# Altium schematic sheet ProjectDescription.SchDoc: =ProjectName
size A3; Author: Hena Chernov; CompanyName: Catcatcat Electronics; Engineer: Hena Chernov; SheetNumber: 1; SheetTotal: 10; Designer: Catcatcat; SheetDescription: Description Project; Email: catcatcat.electronics@gmail.com; CodePhone: +380505759863
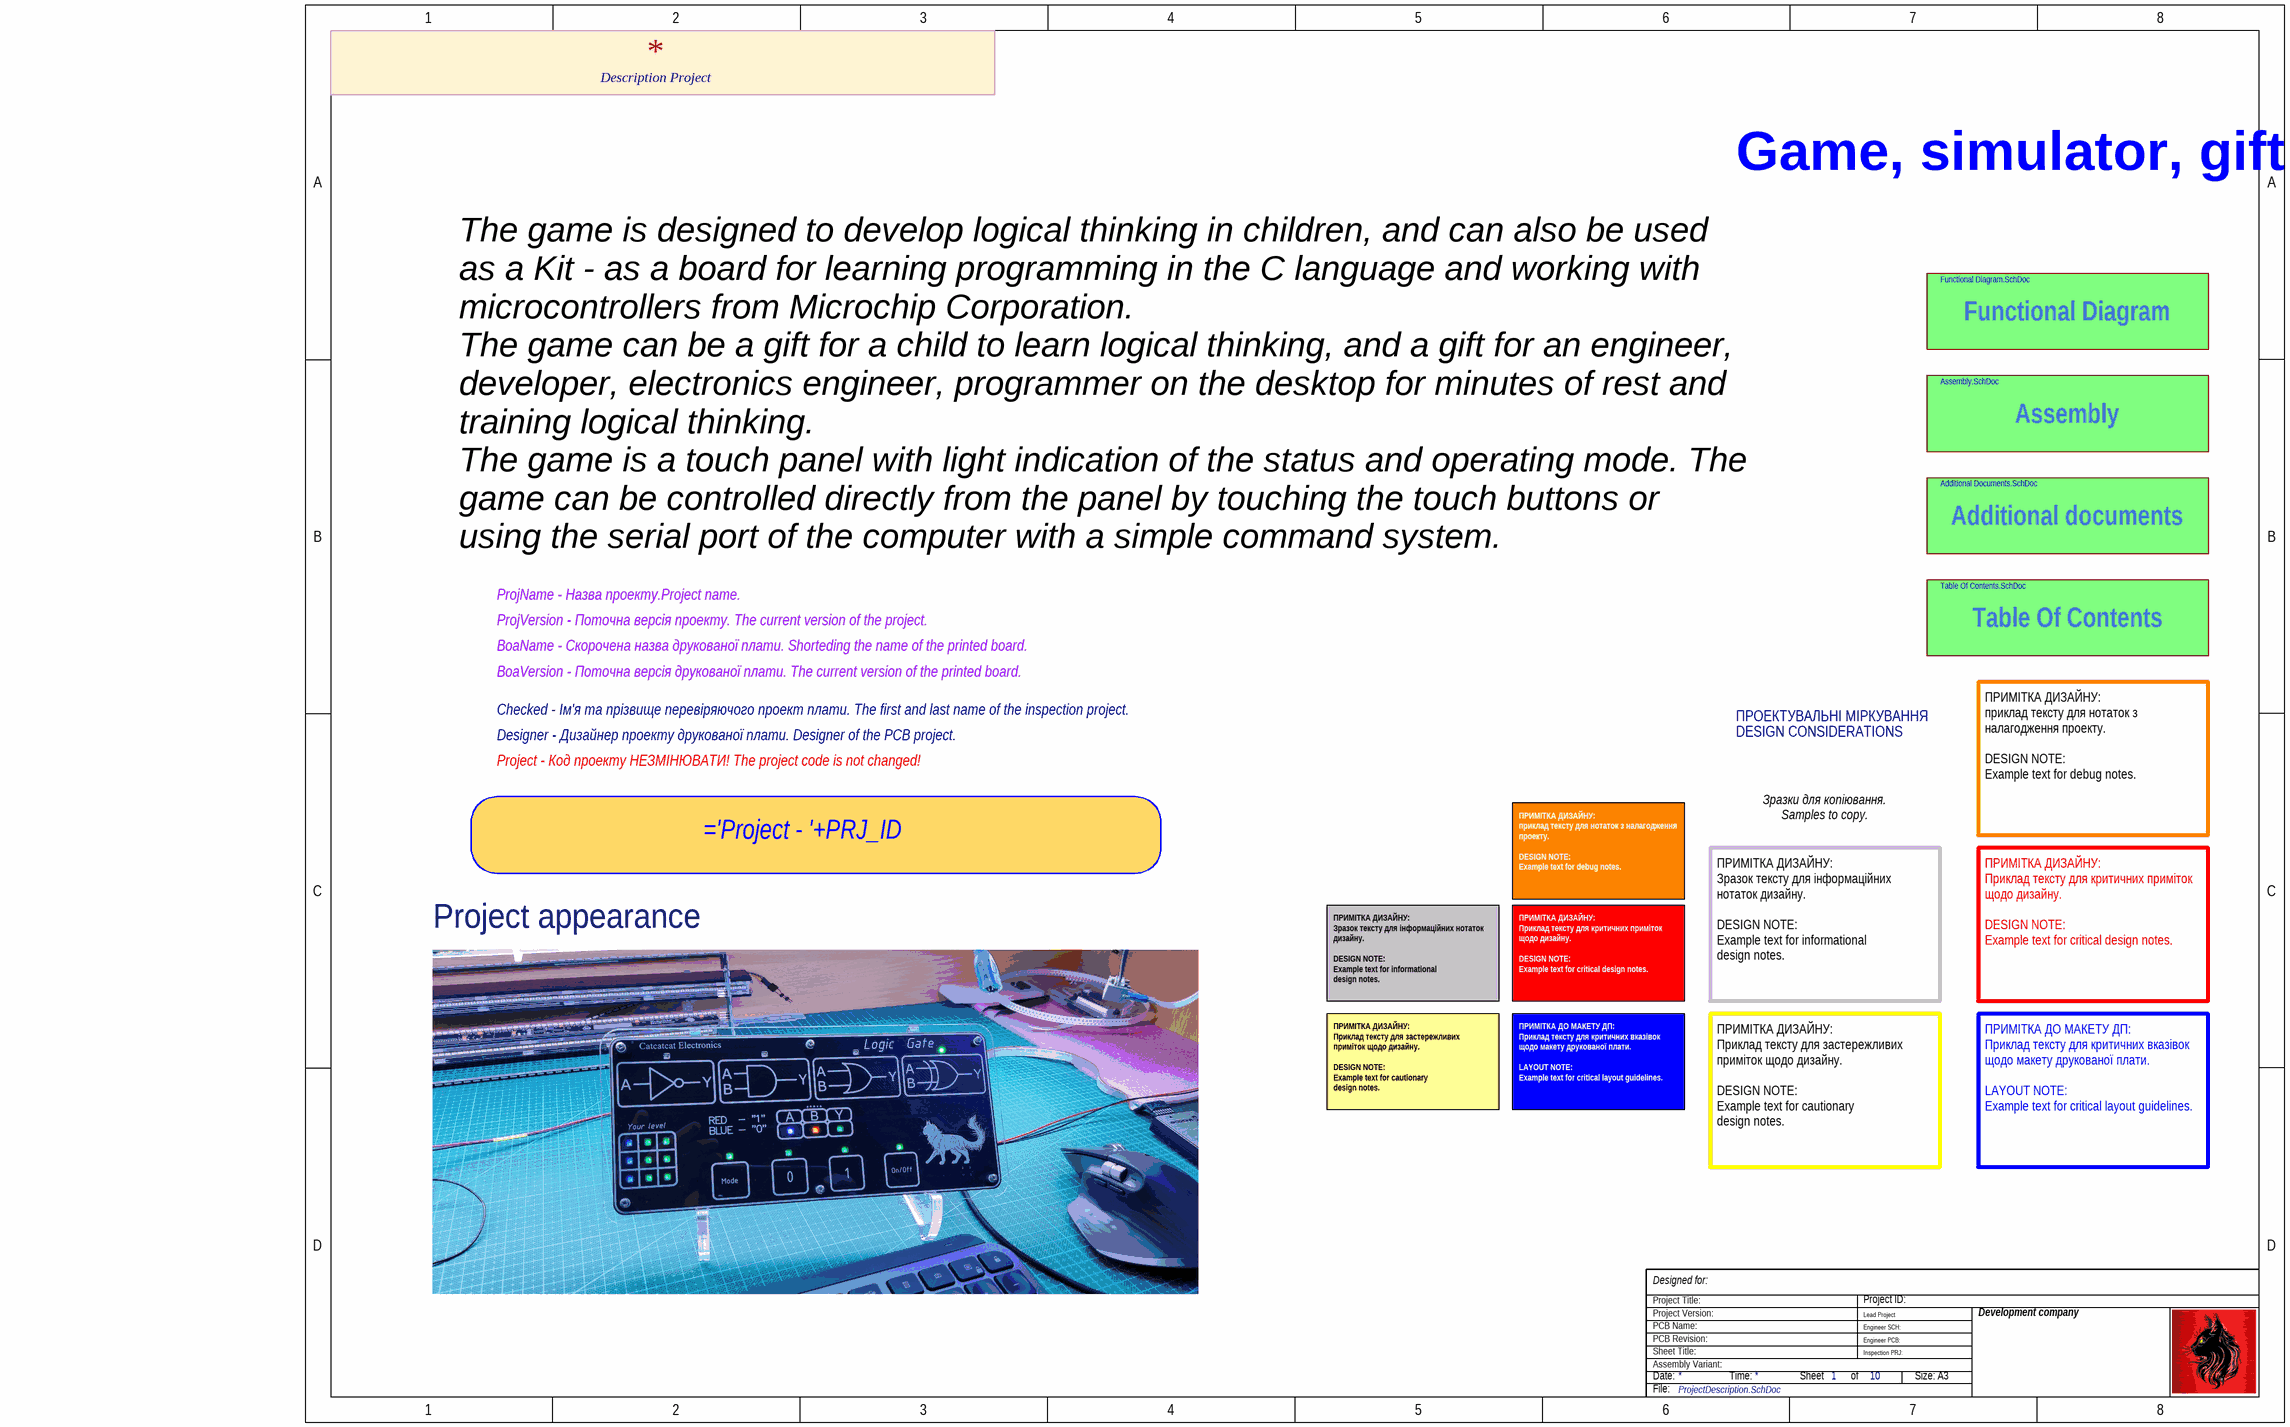
[diagram p0: ProjectDescription.SchDoc]

## Parts
GS1  Graphic symbol  [_S_Project_CAT]  (value not drawn)  (no BOM)

## Sub-sheets
Additional documents = Additional Documents.SchDoc: no entries
Assembly = Assembly.SchDoc: no entries
Functional Diagram = Functional Diagram.SchDoc: no entries
Table Of Contents = Table Of Contents.SchDoc: no entries

## Notes on the sheet
- Game, simulator, gift - development of logical thinking.
- The game is designed to develop logical thinking in children, and can also be used as a Kit - as a board for learning programming in the C language and working with microcontrollers from Microchip Corporation.
  The game can be a gift for a child to learn logical thinking, and a gift for an engineer, developer, electronics engineer, programmer on the desktop for minutes of rest and training logical thinking.
  The game is a touch panel with light indication of the status and operating mode. The game can be controlled directly from the panel by touching the touch buttons or using the serial port of the computer with a simple command system.
- ProjName - Назва проекту.Project name.
- BoaName - Скорочена назва друкованої плати. Shorteding the name of the printed board.
- BoaVersion - Поточна версія друкованої плати. The current version of the printed board.
- ProjVersion - Поточна версія проекту. The current version of the project.
- Checked - Ім'я та прізвище перевіряючого проект плати. The first and last name of the inspection project.
- Designer - Дизайнер проекту друкованої плати. Designer of the PCB project.
- DESIGN CONSIDERATIONS
- ПРОЕКТУВАЛЬНІ МІРКУВАННЯ
- Project - Код проекту НЕЗМІНЮВАТИ! The project code is not changed!
- Зразки для копіювання.
  Samples to copy.
- ПРИМІТКА ДИЗАЙНУ:
  приклад тексту для нотаток з налагодження проекту.
  DESIGN NOTE:
  Example text for debug notes.
- Project appearance
- ПРИМІТКА ДИЗАЙНУ:
  Зразок тексту для інформаційних нотаток дизайну.
  DESIGN NOTE:
  Example text for informational
  design notes.
- ПРИМІТКА ДИЗАЙНУ:
  Приклад тексту для критичних приміток щодо дизайну.
  DESIGN NOTE:
  Example text for critical design notes.
- ПРИМІТКА ДИЗАЙНУ:
  Приклад тексту для застережливих приміток щодо дизайну.
  DESIGN NOTE:
  Example text for cautionary
  design notes.
- ПРИМІТКА ДО МАКЕТУ ДП:
  Приклад тексту для критичних вказівок щодо макету друкованої плати.
  LAYOUT NOTE:
  Example text for critical layout guidelines.
- Project Title:
- Project Version:
- Designed for:
- Lead Project
- Project ID:
- Development company
- Date:
- PCB Revision:
- PCB Name:
- Sheet Title:
- Assembly Variant:
- Time:
- Sheet
- of
- Engineer SCH:
- Engineer PCB:
- Inspection PRJ:
- Size: A3
- File:

## Library data of the parts
GS1 = _S_Project: Graphic symbol for marking on a PCB; Value: *; Assembly type: Graphic symbol; Note: Graphic symbol; Publisher: Catcatcat Electronics; Website developer: http://catcatcat.d-lan.dp.ua/; Footprint check status: Verified; Manufacturer Part Number 1: Graphic symbol; Case/Package: Graphic symbol; Supplier URL 1: https://jlcpcb.com/parts/componentSearch?searchTxt=